# EasyEDA Pro project kuafu01_030内部老化方案.eprj, board PCB4 (continued)
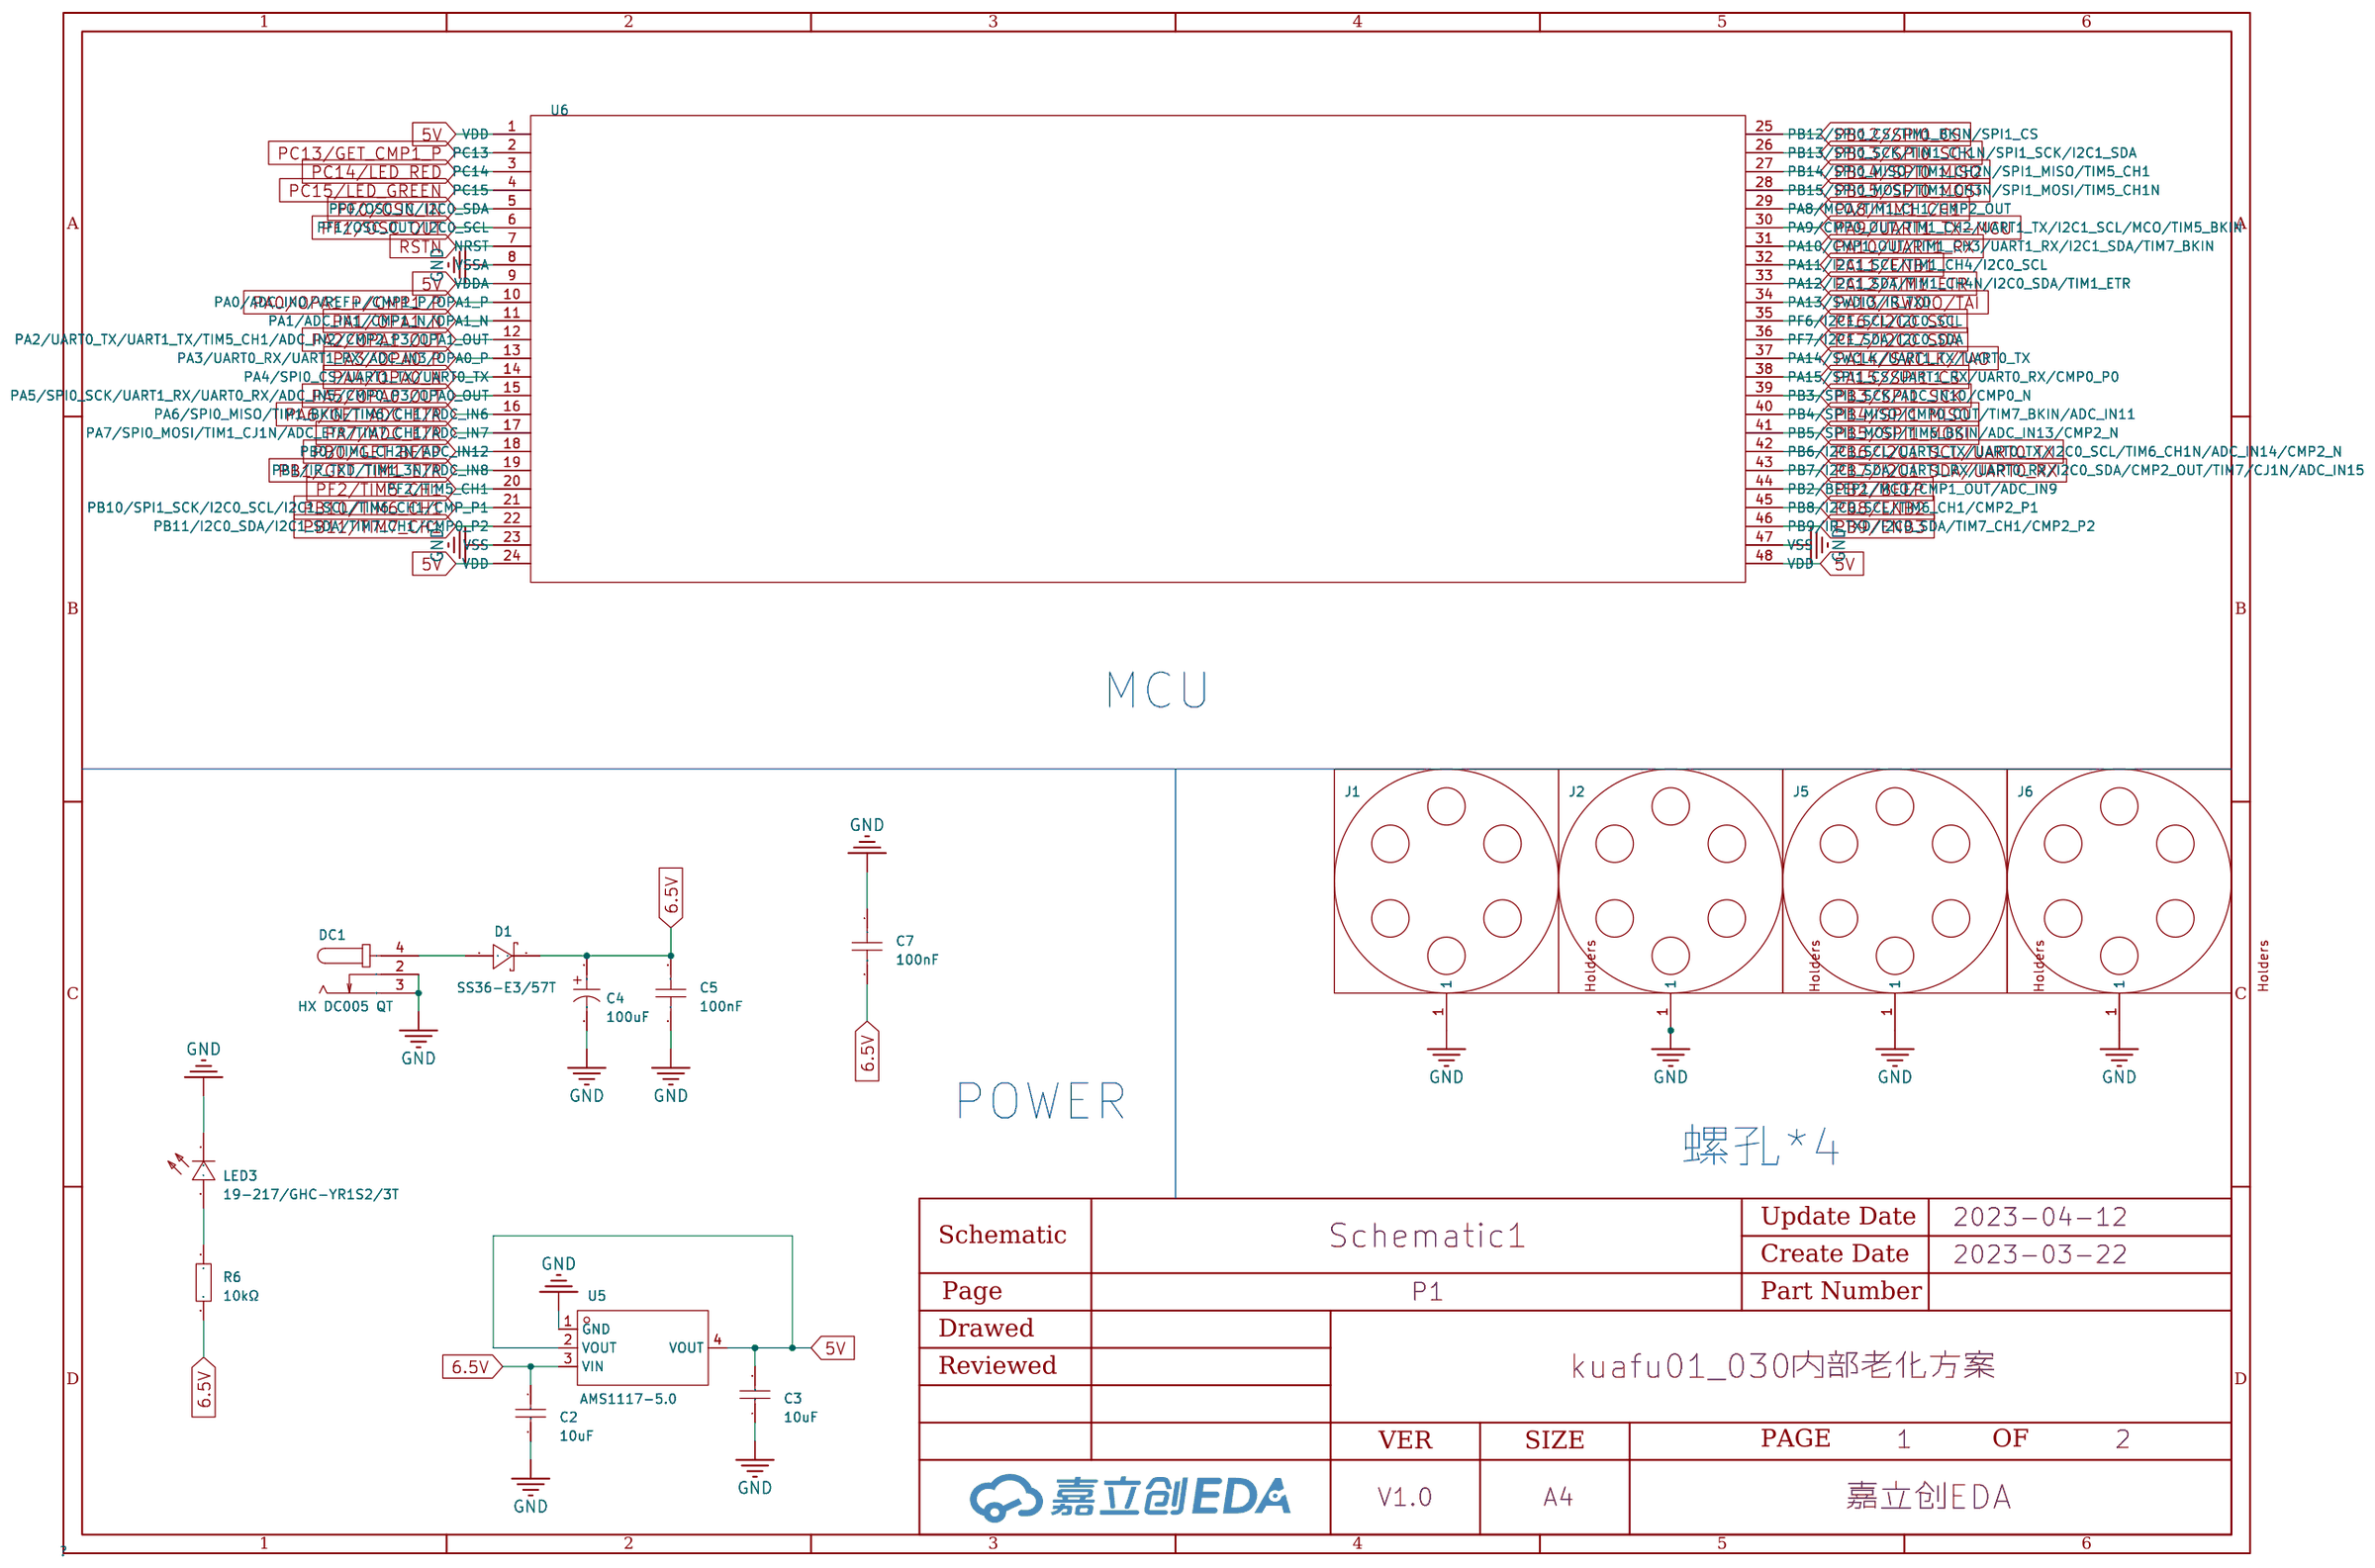
[diagram p0: P1]
## Routing (per net, layer and track width the routed paths; a pad name or vN(x,y) marks a point on that pad's centre or on a via; arc(x,y) is an arc through that point) (continued)
6.5V: length 83.4
  Top Layer w0.508: 50.53,353.74 50.53,348.57 48.81,346.86 47.22,346.86 ; 46.84,337.24 32.89,337.24 31.24,335.6 31.24,333.88 ; 46.84,337.24 62.5,337.24 ; 46.84,337.24 46.86,337.24 46.86,333.76 ; 65.99,353.68 65.79,353.87 50.47,353.87 ; 62.5,337.24 66.12,340.87 66.12,353.66 ; 62.5,337.24 62.57,337.17 62.57,333.7
GND: length 7966.3
  Top Layer w0.254: 155.49,73.33 155.49,71.09 v1(155.49,71.08) ; v1(53.89,172.69) 53.89,172.69 53.89,174.94 ; 257.09,276.53 257.09,274.29 v1(257.09,274.28) ; v1(84.04,124.47) 84.04,126.68 84.96,127.6 98.17,127.6 ; 301.37,178.4 288.16,178.4 287.24,177.48 v1(287.24,175.27) ; 301.37,280 288.16,280 287.24,279.08 v1(287.24,276.87) ; v1(134.84,327.67) 134.84,329.88 135.76,330.8 148.97,330.8 ; 98.17,229.2 84.96,229.2 84.04,228.28 v1(84.04,226.07) ; v1(257.09,20.28) 257.09,20.29 257.09,22.53 ; 257.09,225.73 257.09,223.49 v1(257.09,223.48) ; 301.37,76.8 288.16,76.8 287.24,75.88 v1(287.24,73.67) ; v1(155.49,223.48) 155.49,223.49 155.49,225.73 ; 104.69,174.94 104.69,172.69 v1(104.69,172.69) ; 98.17,178.4 84.96,178.4 84.04,177.48 v1(84.04,175.27) ; 47.37,280 34.16,280 33.24,279.08 v1(33.24,276.87) ; v1(236.44,73.67) 236.44,75.88 237.36,76.8 250.57,76.8 ; 250.57,26 237.36,26 236.44,25.08 v1(236.44,22.87) ; v1(134.84,22.87) 134.84,25.08 135.76,26 148.97,26 ; v1(84.04,22.87) 84.04,25.08 84.96,26 98.17,26 ; v1(104.69,325.08) 104.69,325.09 104.69,327.33 ; 148.97,229.2 135.76,229.2 134.84,228.28 v1(134.84,226.07) ; 257.09,124.13 257.09,121.89 v1(257.09,121.88) ; 104.69,276.53 104.69,274.29 v1(104.69,274.28) ; v1(307.89,325.08) 307.89,325.09 307.89,327.33 ; 307.89,225.73 307.89,223.49 v1(307.89,223.48) ; v1(33.24,124.47) 33.24,126.68 34.16,127.6 47.37,127.6 ; 98.17,330.8 84.96,330.8 84.04,329.88 v1(84.04,327.67) ; 206.29,174.94 206.29,172.69 v1(206.29,172.69) ; v1(53.89,71.08) 53.89,71.09 53.89,73.33 ; 257.09,73.33 257.09,71.09 v1(257.09,71.08) ; 307.89,174.94 307.89,172.69 v1(307.89,172.69) ; 206.29,276.53 206.29,274.29 v1(206.29,274.28) ; v1(155.49,325.08) 155.49,325.09 155.49,327.33 ; v1(53.89,20.28) 53.89,20.29 53.89,22.53 ; v1(185.64,327.67) 185.64,329.88 186.56,330.8 199.77,330.8 ; v1(287.24,327.67) 287.24,329.88 288.16,330.8 301.37,330.8 ; v1(33.24,22.87) 33.24,25.08 34.16,26 47.37,26 ; v1(104.69,121.88) 104.69,121.89 104.69,124.13 ; 53.89,225.73 53.89,223.49 v1(53.89,223.48) ; v1(53.89,121.88) 53.89,121.89 53.89,124.13 ; 47.37,76.8 34.16,76.8 33.24,75.88 v1(33.24,73.67) ; 148.97,178.4 135.76,178.4 134.84,177.48 v1(134.84,175.27) ; v1(257.09,172.69) 257.09,172.69 257.09,174.94 ; v1(206.29,121.88) 206.29,121.89 206.29,124.13 ; v1(134.84,73.67) 134.84,75.88 135.76,76.8 148.97,76.8 ; v1(206.29,71.08) 206.29,71.09 206.29,73.33 ; 155.49,276.53 155.49,274.29 v1(155.49,274.28) ; v1(84.04,276.87) 84.04,279.08 84.96,280 98.17,280 ; 199.77,76.8 186.56,76.8 185.64,75.88 v1(185.64,73.67) ; v1(155.49,20.28) 155.49,20.29 155.49,22.53 ; v1(33.24,226.07) 33.24,228.28 34.16,229.2 47.37,229.2 ; 148.97,280 135.76,280 134.84,279.08 v1(134.84,276.87) ; v1(307.89,71.08) 307.89,71.09 307.89,73.33 ; v1(206.29,325.08) 206.29,325.09 206.29,327.33 ; 250.57,127.6 237.36,127.6 236.44,126.68 v1(236.44,124.47) ; v1(206.29,223.48) 206.29,223.49 206.29,225.73 ; 199.77,26 186.56,26 185.64,25.08 v1(185.64,22.87) ; 155.49,174.94 155.49,172.69 v1(155.49,172.69) ; v1(104.69,223.48) 104.69,223.49 104.69,225.73 ; 250.57,229.2 237.36,229.2 236.44,228.28 v1(236.44,226.07) ; v1(307.89,121.88) 307.89,121.89 307.89,124.13 ; v1(236.44,175.27) 236.44,177.48 237.36,178.4 250.57,178.4 ; 47.37,178.4 34.16,178.4 33.24,177.48 v1(33.24,175.27) ; 104.69,22.53 104.69,20.29 v1(104.69,20.28) ; 250.57,330.8 237.36,330.8 236.44,329.88 v1(236.44,327.67) ; v1(185.64,124.47) 185.64,126.68 186.56,127.6 199.77,127.6 ; v1(185.64,276.87) 185.64,279.08 186.56,280 199.77,280 ; 301.37,127.6 288.16,127.6 287.24,126.68 v1(287.24,124.47) ; 257.09,327.33 257.09,325.09 v1(257.09,325.08) ; 250.57,280 237.36,280 236.44,279.08 v1(236.44,276.87) ; v1(206.29,20.28) 206.29,20.29 206.29,22.53 ; 199.77,229.2 186.56,229.2 185.64,228.28 v1(185.64,226.07) ; 307.89,276.53 307.89,274.29 v1(307.89,274.28) ; v1(104.69,71.08) 104.69,71.09 104.69,73.33 ; 155.49,124.13 155.49,121.89 v1(155.49,121.88) ; v1(53.89,274.28) 53.89,274.29 53.89,276.53 ; 301.37,229.2 288.16,229.2 287.24,228.28 v1(287.24,226.07) ; v1(185.64,175.27) 185.64,177.48 186.56,178.4 199.77,178.4 ; 148.97,127.6 135.76,127.6 134.84,126.68 v1(134.84,124.47) ; 98.17,76.8 84.96,76.8 84.04,75.88 v1(84.04,73.67)
  Top Layer w0.381: v1(34.08,121.9) 34.91,121.07 36.25,121.07 ; 303.38,183.36 303.38,184.27 v1(302.96,184.69) ; v1(99.76,32.29) 100.18,31.87 100.18,30.96 ; v1(252.16,133.89) 252.58,133.47 252.58,132.56 ; 197.97,290.08 198.3,290.41 198.78,290.41 v1(198.81,290.37) ; 197.97,290.08 197.97,289.41 197.92,289.35 ; 197.97,290.08 196.71,291.34 v1(196.71,292.84) ; v1(46.41,36.37) 46.38,36.41 45.9,36.41 45.57,36.08 ; 36.25,19.47 34.91,19.47 v1(34.08,20.3) ; 96.37,86.88 95.11,88.14 v1(95.11,89.64) ; 96.37,86.88 96.37,86.21 96.32,86.16 ; 96.37,86.88 96.7,87.21 97.18,87.21 v1(97.21,87.17) ; 96.32,35.35 96.37,35.41 96.37,36.08 ; 150.98,81.76 150.98,82.67 v1(150.56,83.09) ; 197.92,86.16 197.97,86.21 197.97,86.88 ; v1(148.01,87.17) 147.98,87.21 147.5,87.21 147.17,86.88 ; 303.38,284.96 303.38,285.87 v1(302.96,286.29) ; v1(237.28,325.1) 238.11,324.27 239.45,324.27 ; 147.17,239.28 147.17,238.61 147.12,238.56 ; 147.17,239.28 147.5,239.61 147.98,239.61 v1(148.01,239.57) ; 147.17,239.28 145.91,240.54 v1(145.91,242.04) ; 201.78,132.56 201.78,133.47 v1(201.36,133.89) ; v1(90.63,122.64) 90.63,122.58 92.45,120.76 93.09,120.76 93.14,120.7 93.19,120.66 ; 143.99,120.66 143.94,120.7 143.89,120.76 143.25,120.76 141.43,122.58 v1(141.43,122.64) ; v1(252.16,32.29) 252.58,31.87 252.58,30.96 ; v1(148.01,137.97) 147.98,138.01 147.5,138.01 147.17,137.68 ; v1(135.68,223.5) 136.51,222.67 137.85,222.67 ; v1(34.08,71.1) 34.91,70.27 36.25,70.27 ; v1(196.71,38.84) 196.71,37.34 197.97,36.08 ; 150.98,234.16 150.98,235.07 v1(150.56,235.49) ; 137.8,334.78 139.26,333.32 ; v1(192.23,71.84) 192.23,71.78 194.05,69.96 194.69,69.96 194.74,69.9 194.79,69.86 ; v1(201.36,83.09) 201.78,82.67 201.78,81.76 ; 45.57,36.08 44.31,37.34 v1(44.31,38.84) ; 45.57,36.08 45.57,35.41 45.52,35.35 ; 248.77,290.08 249.1,290.41 249.58,290.41 v1(249.61,290.37) ; 248.77,290.08 247.51,291.34 v1(247.51,292.84) ; 248.77,290.08 248.77,289.41 248.72,289.35 ; 87.05,222.67 85.71,222.67 v1(84.88,223.5) ; 290.25,171.87 288.91,171.87 v1(288.08,172.7) ; 299.57,340.88 298.31,342.14 v1(298.31,343.64) ; 299.57,340.88 299.9,341.21 300.38,341.21 v1(300.41,341.17) ; 299.57,340.88 299.57,340.21 299.52,340.15 ; 100.18,183.36 100.18,184.27 v1(99.76,184.69) ; v1(97.21,188.77) 97.18,188.81 96.7,188.81 96.37,188.48 ; 194.79,323.86 194.74,323.9 194.69,323.96 194.05,323.96 192.23,325.78 v1(192.23,325.84) ; 36.2,29.98 37.66,28.52 ; v1(97.21,290.37) 97.18,290.41 96.7,290.41 96.37,290.08 ; 290.2,233.18 291.66,231.72 ; 197.97,137.68 198.3,138.01 198.78,138.01 v1(198.81,137.97) ; 197.97,137.68 197.97,137.01 197.92,136.95 ; 197.97,137.68 196.71,138.94 v1(196.71,140.44) ; v1(150.56,337.09) 150.98,336.67 150.98,335.76 ; v1(237.28,71.1) 238.11,70.27 239.45,70.27 ; 248.77,340.88 249.1,341.21 249.58,341.21 v1(249.61,341.17) ; 248.77,340.88 248.77,340.21 248.72,340.15 ; 248.77,340.88 247.51,342.14 v1(247.51,343.64) ; 248.77,86.88 248.77,86.21 248.72,86.16 ; 248.77,86.88 247.51,88.14 v1(247.51,89.64) ; 248.77,86.88 249.1,87.21 249.58,87.21 v1(249.61,87.17) ; v1(39.83,21.04) 39.83,20.98 41.65,19.16 42.29,19.16 42.34,19.1 42.39,19.06 ; 248.77,239.28 249.1,239.61 249.58,239.61 v1(249.61,239.57) ; 248.77,239.28 247.51,240.54 v1(247.51,242.04) ; 248.77,239.28 248.77,238.61 248.72,238.56 ; 49.38,132.56 49.38,133.47 v1(48.96,133.89) ; v1(95.11,242.04) 95.11,240.54 96.37,239.28 ; v1(141.43,224.24) 141.43,224.18 143.25,222.36 143.89,222.36 143.94,222.3 143.99,222.26 ; 45.57,86.88 45.57,86.21 45.52,86.16 ; 45.57,86.88 45.9,87.21 46.38,87.21 v1(46.41,87.17) ; 45.57,86.88 44.31,88.14 v1(44.31,89.64) ; v1(249.61,36.37) 249.58,36.41 249.1,36.41 248.77,36.08 ; v1(302.96,337.09) 303.38,336.67 303.38,335.76 ; v1(90.63,21.04) 90.63,20.98 92.45,19.16 93.09,19.16 93.14,19.1 93.19,19.06 ; v1(150.56,184.69) 150.98,184.27 150.98,183.36 ; v1(237.28,172.7) 238.11,171.87 239.45,171.87 ; 197.97,340.88 196.71,342.14 v1(196.71,343.64) ; 197.97,340.88 197.97,340.21 197.92,340.15 ; 197.97,340.88 198.3,341.21 198.78,341.21 v1(198.81,341.17) ; 45.57,290.08 45.9,290.41 46.38,290.41 v1(46.41,290.37) ; 45.57,290.08 45.57,289.41 45.52,289.35 ; 45.57,290.08 44.31,291.34 v1(44.31,292.84) ; 42.39,120.66 42.34,120.7 42.29,120.76 41.65,120.76 39.83,122.58 v1(39.83,122.64) ; 252.58,335.76 252.58,336.67 v1(252.16,337.09) ; v1(46.41,239.57) 46.38,239.61 45.9,239.61 45.57,239.28 ; 143.99,19.06 143.94,19.1 143.89,19.16 143.25,19.16 141.43,20.98 v1(141.43,21.04) ; v1(46.41,137.97) 46.38,138.01 45.9,138.01 45.57,137.68 ; 194.79,19.06 194.74,19.1 194.69,19.16 194.05,19.16 192.23,20.98 v1(192.23,21.04) ; v1(97.21,239.57) 97.18,239.61 96.7,239.61 96.37,239.28 ; 239.45,273.47 238.11,273.47 v1(237.28,274.3) ; v1(99.76,133.89) 100.18,133.47 100.18,132.56 ; v1(302.96,235.49) 303.38,235.07 303.38,234.16 ; v1(48.96,32.29) 49.38,31.87 49.38,30.96 ; v1(252.16,184.69) 252.58,184.27 252.58,183.36 ; v1(135.68,172.7) 136.51,171.87 137.85,171.87 ; 100.18,284.96 100.18,285.87 v1(99.76,286.29) ; 188.65,273.47 187.31,273.47 v1(186.48,274.3) ; 194.79,273.06 194.74,273.1 194.69,273.16 194.05,273.16 192.23,274.98 v1(192.23,275.04) ; 45.57,137.68 45.57,137.01 45.52,136.95 ; 45.57,137.68 44.31,138.94 v1(44.31,140.44) ; 147.17,340.88 147.17,340.21 147.12,340.15 ; 147.17,340.88 147.5,341.21 147.98,341.21 v1(148.01,341.17) ; 147.17,340.88 145.91,342.14 v1(145.91,343.64) ; v1(90.63,275.04) 90.63,274.98 92.45,273.16 93.09,273.16 93.14,273.1 93.19,273.06 ; 93.19,171.46 93.14,171.5 93.09,171.56 92.45,171.56 90.63,173.38 v1(90.63,173.44) ; v1(288.08,325.1) 288.91,324.27 290.25,324.27 ; 248.77,137.68 248.77,137.01 248.72,136.95 ; 248.77,137.68 249.1,138.01 249.58,138.01 v1(249.61,137.97) ; 248.77,137.68 247.51,138.94 v1(247.51,140.44) ; 188.65,121.07 187.31,121.07 v1(186.48,121.9) ; 96.37,188.48 96.37,187.81 96.32,187.75 ; 96.37,188.48 95.11,189.74 v1(95.11,191.24) ; 87.05,70.27 85.71,70.27 v1(84.88,71.1) ; v1(298.31,191.24) 298.31,189.74 299.57,188.48 ; v1(243.03,122.64) 243.03,122.58 244.85,120.76 245.49,120.76 245.54,120.7 245.59,120.66 ; 147.17,86.88 145.91,88.14 v1(145.91,89.64) ; 147.17,86.88 147.17,86.21 147.12,86.16 ; v1(293.83,122.64) 293.83,122.58 295.65,120.76 296.29,120.76 296.34,120.7 296.39,120.66 ; 96.37,290.08 96.37,289.41 96.32,289.35 ; 96.37,290.08 95.11,291.34 v1(95.11,292.84) ; 143.99,273.06 143.94,273.1 143.89,273.16 143.25,273.16 141.43,274.98 v1(141.43,275.04) ; v1(300.41,188.77) 300.38,188.81 299.9,188.81 299.57,188.48 ; 299.57,86.88 299.57,86.21 299.52,86.16 ; 299.57,86.88 299.9,87.21 300.38,87.21 v1(300.41,87.17) ; 299.57,86.88 298.31,88.14 v1(298.31,89.64) ; 188.6,29.98 190.06,28.52 ; 87,29.98 88.46,28.52 ; 188.6,334.78 190.06,333.32 ; 100.18,81.76 100.18,82.67 v1(99.76,83.09) ; 188.65,19.47 187.31,19.47 v1(186.48,20.3) ; v1(135.68,325.1) 136.51,324.27 137.85,324.27 ; v1(247.51,191.24) 247.51,189.74 248.77,188.48 ; 147.17,36.08 145.91,37.34 v1(145.91,38.84) ; 147.17,36.08 147.5,36.41 147.98,36.41 v1(148.01,36.37) ; 147.17,36.08 147.17,35.41 147.12,35.35 ; v1(34.08,172.7) 34.91,171.87 36.25,171.87 ; v1(293.83,71.84) 293.83,71.78 295.65,69.96 296.29,69.96 296.34,69.9 296.39,69.86 ; v1(237.28,20.3) 238.11,19.47 239.45,19.47 ; 96.32,136.95 96.37,137.01 96.37,137.68 ; 248.72,35.35 248.77,35.41 248.77,36.08 ; v1(150.56,32.29) 150.98,31.87 150.98,30.96 ; 239.45,121.07 238.11,121.07 v1(237.28,121.9) ; 197.97,188.48 198.3,188.81 198.78,188.81 v1(198.81,188.77) ; 197.97,188.48 197.97,187.81 197.92,187.75 ; 197.97,188.48 196.71,189.74 v1(196.71,191.24) ; v1(48.96,83.09) 49.38,82.67 49.38,81.76 ; 137.85,19.47 136.51,19.47 v1(135.68,20.3) ; v1(48.96,286.29) 49.38,285.87 49.38,284.96 ; 248.77,188.48 248.77,187.81 248.72,187.75 ; 248.77,188.48 249.1,188.81 249.58,188.81 v1(249.61,188.77) ; 194.79,222.26 194.74,222.3 194.69,222.36 194.05,222.36 192.23,224.18 v1(192.23,224.24) ; 96.37,239.28 96.37,238.61 96.32,238.56 ; v1(48.96,184.69) 49.38,184.27 49.38,183.36 ; 197.92,238.56 197.97,238.61 197.97,239.28 ; 147.17,188.48 147.5,188.81 147.98,188.81 v1(148.01,188.77) ; 147.17,188.48 147.17,187.81 147.12,187.75 ; 147.17,188.48 145.91,189.74 v1(145.91,191.24) ; 245.59,273.06 245.54,273.1 245.49,273.16 244.85,273.16 243.03,274.98 v1(243.03,275.04) ; 36.2,80.78 37.66,79.32 ; 188.65,70.27 187.31,70.27 v1(186.48,71.1) ; 188.65,324.27 187.31,324.27 v1(186.48,325.1) ; v1(39.83,224.24) 39.83,224.18 41.65,222.36 42.29,222.36 42.34,222.3 42.39,222.26 ; 87,334.78 88.46,333.32 ; 147.17,137.68 145.91,138.94 v1(145.91,140.44) ; 147.17,137.68 147.17,137.01 147.12,136.95 ; v1(90.63,71.84) 90.63,71.78 92.45,69.96 93.09,69.96 93.14,69.9 93.19,69.86 ; 36.2,131.58 37.66,130.12 ; v1(97.21,36.37) 97.18,36.41 96.7,36.41 96.37,36.08 ; 303.38,81.76 303.38,82.67 v1(302.96,83.09) ; 299.57,239.28 299.57,238.61 299.52,238.56 ; 299.57,239.28 298.31,240.54 v1(298.31,242.04) ; 299.57,239.28 299.9,239.61 300.38,239.61 v1(300.41,239.57) ; 45.57,239.28 45.57,238.61 45.52,238.56 ; 45.57,239.28 44.31,240.54 v1(44.31,242.04) ; 96.37,36.08 95.11,37.34 v1(95.11,38.84) ; v1(90.63,224.24) 90.63,224.18 92.45,222.36 93.09,222.36 93.14,222.3 93.19,222.26 ; 299.57,188.48 299.57,187.81 299.52,187.75 ; 197.97,239.28 196.71,240.54 v1(196.71,242.04) ; 197.97,239.28 198.3,239.61 198.78,239.61 v1(198.81,239.57) ; v1(150.56,133.89) 150.98,133.47 150.98,132.56 ; v1(135.68,71.1) 136.51,70.27 137.85,70.27 ; v1(141.43,71.84) 141.43,71.78 143.25,69.96 143.89,69.96 143.94,69.9 143.99,69.86 ; 201.78,30.96 201.78,31.87 v1(201.36,32.29) ; 45.57,188.48 44.31,189.74 v1(44.31,191.24) ; 45.57,188.48 45.9,188.81 46.38,188.81 v1(46.41,188.77) ; 45.57,188.48 45.57,187.81 45.52,187.75 ; v1(252.16,286.29) 252.58,285.87 252.58,284.96 ; 248.77,36.08 247.51,37.34 v1(247.51,38.84) ; 42.39,171.46 42.34,171.5 42.29,171.56 41.65,171.56 39.83,173.38 v1(39.83,173.44) ; v1(201.36,337.09) 201.78,336.67 201.78,335.76 ; 188.65,222.67 187.31,222.67 v1(186.48,223.5) ; 87,233.18 88.46,231.72 ; 137.8,283.98 139.26,282.52 ; v1(99.76,337.09) 100.18,336.67 100.18,335.76 ; v1(95.11,343.64) 95.11,342.14 96.37,340.88 ; 299.52,136.95 299.57,137.01 299.57,137.68 ; 87.05,273.47 85.71,273.47 v1(84.88,274.3) ; v1(201.36,235.49) 201.78,235.07 201.78,234.16 ; v1(201.36,184.69) 201.78,184.27 201.78,183.36 ; 36.2,283.98 37.66,282.52 ; v1(252.16,235.49) 252.58,235.07 252.58,234.16 ; 100.18,234.16 100.18,235.07 v1(99.76,235.49) ; 290.2,80.78 291.66,79.32 ; 245.59,19.06 245.54,19.1 245.49,19.16 244.85,19.16 243.03,20.98 v1(243.03,21.04) ; 188.6,182.38 190.06,180.92 ; 96.37,137.68 96.7,138.01 97.18,138.01 v1(97.21,137.97) ; 96.37,137.68 95.11,138.94 v1(95.11,140.44) ; v1(39.83,71.84) 39.83,71.78 41.65,69.96 42.29,69.96 42.34,69.9 42.39,69.86 ; 87,182.38 88.46,180.92 ; 290.2,131.58 291.66,130.12 ; v1(252.16,83.09) 252.58,82.67 252.58,81.76 ; 290.25,273.47 288.91,273.47 v1(288.08,274.3) ; v1(39.83,275.04) 39.83,274.98 41.65,273.16 42.29,273.16 42.34,273.1 42.39,273.06 ; 299.57,290.08 298.31,291.34 v1(298.31,292.84) ; 299.57,290.08 299.9,290.41 300.38,290.41 v1(300.41,290.37) ; 299.57,290.08 299.57,289.41 299.52,289.35 ; 96.37,340.88 96.7,341.21 97.18,341.21 v1(97.21,341.17) ; 96.37,340.88 96.37,340.21 96.32,340.15 ; 87,80.78 88.46,79.32 ; 245.59,69.86 245.54,69.9 245.49,69.96 244.85,69.96 243.03,71.78 v1(243.03,71.84) ; v1(48.96,235.49) 49.38,235.07 49.38,234.16 ; 239.4,233.18 240.86,231.72 ; v1(201.36,286.29) 201.78,285.87 201.78,284.96 ; v1(243.03,325.84) 243.03,325.78 244.85,323.96 245.49,323.96 245.54,323.9 245.59,323.86 ; v1(34.08,223.5) 34.91,222.67 36.25,222.67 ; v1(148.01,290.37) 147.98,290.41 147.5,290.41 147.17,290.08 ; 197.97,36.08 197.97,35.41 197.92,35.35 ; 197.97,36.08 198.3,36.41 198.78,36.41 v1(198.81,36.37) ; v1(288.08,71.1) 288.91,70.27 290.25,70.27 ; v1(293.83,173.44) 293.83,173.38 295.65,171.56 296.29,171.56 296.34,171.5 296.39,171.46 ; 87.05,171.87 85.71,171.87 v1(84.88,172.7) ; v1(198.81,87.17) 198.78,87.21 198.3,87.21 197.97,86.88 ; v1(84.88,325.1) 85.71,324.27 87.05,324.27 ; 147.17,290.08 145.91,291.34 v1(145.91,292.84) ; 147.17,290.08 147.17,289.41 147.12,289.35 ; 299.57,137.68 298.31,138.94 v1(298.31,140.44) ; 299.57,137.68 299.9,138.01 300.38,138.01 v1(300.41,137.97) ; 194.79,120.66 194.74,120.7 194.69,120.76 194.05,120.76 192.23,122.58 v1(192.23,122.64) ; v1(192.23,173.44) 192.23,173.38 194.05,171.56 194.69,171.56 194.74,171.5 194.79,171.46 ; 290.2,283.98 291.66,282.52 ; 137.85,273.47 136.51,273.47 v1(135.68,274.3) ; 239.4,80.78 240.86,79.32 ; 188.6,131.58 190.06,130.12 ; 296.39,323.86 296.34,323.9 296.29,323.96 295.65,323.96 293.83,325.78 v1(293.83,325.84) ; 137.8,29.98 139.26,28.52 ; 87,283.98 88.46,282.52 ; v1(196.71,89.64) 196.71,88.14 197.97,86.88 ; 36.25,273.47 34.91,273.47 v1(34.08,274.3) ; 188.6,283.98 190.06,282.52 ; 137.8,131.58 139.26,130.12 ; 296.39,222.26 296.34,222.3 296.29,222.36 295.65,222.36 293.83,224.18 v1(293.83,224.24) ; v1(84.88,20.3) 85.71,19.47 87.05,19.47 ; 36.2,182.38 37.66,180.92 ; v1(84.88,121.9) 85.71,121.07 87.05,121.07 ; 303.38,132.56 303.38,133.47 v1(302.96,133.89) ; 188.6,233.18 190.06,231.72 ; 239.4,131.58 240.86,130.12 ; 36.2,233.18 37.66,231.72 ; 290.25,121.07 288.91,121.07 v1(288.08,121.9) ; 87,131.58 88.46,130.12 ; 93.19,323.86 93.14,323.9 93.09,323.96 92.45,323.96 90.63,325.78 v1(90.63,325.84) ; 290.2,182.38 291.66,180.92 ; 239.4,29.98 240.86,28.52 ; 239.45,222.67 238.11,222.67 v1(237.28,223.5) ; 245.59,171.46 245.54,171.5 245.49,171.56 244.85,171.56 243.03,173.38 v1(243.03,173.44) ; 143.99,171.46 143.94,171.5 143.89,171.56 143.25,171.56 141.43,173.38 v1(141.43,173.44) ; v1(293.83,275.04) 293.83,274.98 295.65,273.16 296.29,273.16 296.34,273.1 296.39,273.06 ; 239.4,283.98 240.86,282.52 ; 137.8,182.38 139.26,180.92 ; 137.8,80.78 139.26,79.32 ; 245.59,222.26 245.54,222.3 245.49,222.36 244.85,222.36 243.03,224.18 v1(243.03,224.24) ; v1(135.68,121.9) 136.51,121.07 137.85,121.07 ; v1(150.56,286.29) 150.98,285.87 150.98,284.96 ; v1(288.08,223.5) 288.91,222.67 290.25,222.67 ; v1(186.48,172.7) 187.31,171.87 188.65,171.87 ; 188.6,80.78 190.06,79.32 ; 290.2,334.78 291.66,333.32 ; 137.8,233.18 139.26,231.72 ; 239.4,182.38 240.86,180.92 ; 143.99,323.86 143.94,323.9 143.89,323.96 143.25,323.96 141.43,325.78 v1(141.43,325.84) ; 239.4,334.78 240.86,333.32